# EasyEDA Pro project Jarvis.eprj, schematic Schematic8_1
Board Name: MotherBoard_1; Create Date: 2026-04-19; Page Name: P1; Project Name: Jarvis; Schematic Name: Schematic8_1; Update Date: 2026-04-19; Company: EasyEDA.com; Page Size: A4; Version: V1.0
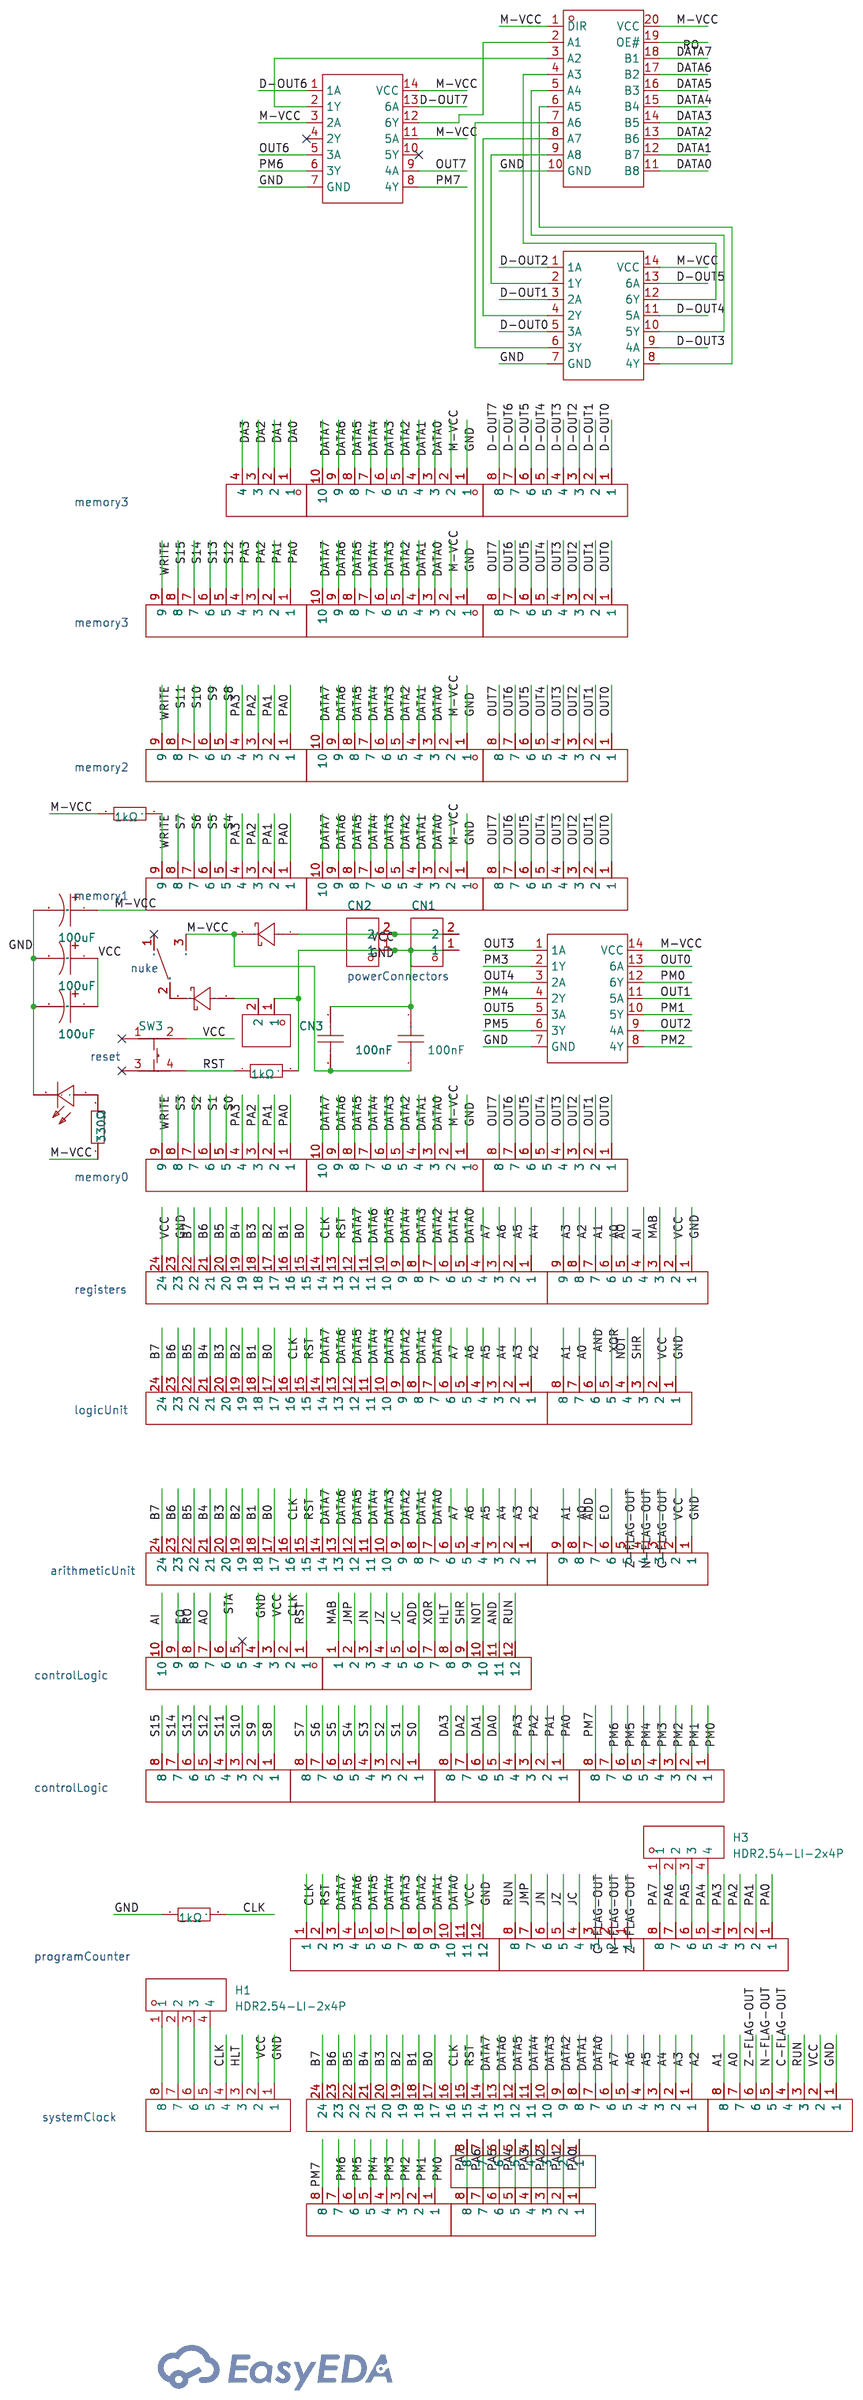
[diagram p8: schematic sheet]

## Parts
C40  100uF  [CAP-TH_BD6.3-P2.50-D1.0-FD]
C66  100nF  [CAP-TH_L5.0-W2.5-P5.00-D1.0]
C67  100nF  [CAP-TH_L5.0-W2.5-P5.00-D1.0]
C68  100uF  [CAP-TH_BD6.3-P2.50-D1.0-FD]
C69  100uF  [CAP-TH_BD6.3-P2.50-D1.0-FD]
CN1  MX7620-7.62-02P-BK01-Cu-S-A  [CONN-TH_2P-P7.62_MX7620-7.62-02P-BK01-CU-S-A]
CN2  MX7620-7.62-02P-BK01-Cu-S-A  [CONN-TH_2P-P7.62_MX7620-7.62-02P-BK01-CU-S-A]
CN3  MX7620-7.62-02P-BK01-Cu-S-A  [CONN-TH_2P-P7.62_MX7620-7.62-02P-BK01-CU-S-A]
H1  HDR2.54-LI-2x4P  [HDR-TH_4P-P2.54-V-M]
H2  HDR2.54-LI-2x4P  [HDR-TH_4P-P2.54-V-M]
H3  HDR2.54-LI-2x4P  [HDR-TH_4P-P2.54-V-M]
R59  1kΩ  [RES-TH_BD2.3-L6.5-P10.50-D0.5]
R61  1kΩ  [RES-TH_BD2.3-L6.5-P10.50-D0.5]
R62  1kΩ  [RES-TH_BD2.3-L6.5-P10.50-D0.5]
R63  330Ω  [RES-TH_BD2.3-L6.5-P10.50-D0.5]
SW3  B3F-1000-S  [KEY-TH_4P-L6.2-W6.2-P4.50-LS6.5]
U5  SN74HC245N3  [PDIP-20_L25.9-W6.6-P2.54-LS7.9-BL]
U7  TH2.54_8P_0.6  [HDR-TH_8P-P2.54-V-M-3]
U8  TH2.54_8P_0.6  [HDR-TH_8P-P2.54-V-M-3]
U210  SN74HC04N(LX)  [DIP-14_L19.6-W6.4-P2.54-LS7.6-BL]
U356  TH2.54_8P_0.6  [HDR-TH_8P-P2.54-V-M-3]
U377  HDR2.54-LI-9P  [HDR-TH_9P-P2.54-V-M]
U382  TH2.54_8P_0.6  [HDR-TH_8P-P2.54-V-M-3]
U384  TH2.54-24P排针(母)(邮寄专用)  [HDR-TH_24P-P2.54-V-F]
U385  cn10_2r54_10x1  [HDR-TH_10P-P2.54-V-F]
U386  D22030200553-HDR-TH_12P-P2.54-V-F  [HDR-TH_12P-P2.54-V-F]
U387  TH2.54_8P_0.6  [HDR-TH_8P-P2.54-V-M-3]
U388  TH2.54_8P_0.6  [HDR-TH_8P-P2.54-V-M-3]
U390  HDR2.54-LI-9P  [HDR-TH_9P-P2.54-V-M]
U400  TH2.54_8P_0.6  [HDR-TH_8P-P2.54-V-M-3]
U410  cn10_2r54_10x1  [HDR-TH_10P-P2.54-V-F]
U411  D22030200553-HDR-TH_12P-P2.54-V-F  [HDR-TH_12P-P2.54-V-F]
U412  TH2.54-24P排针(母)(邮寄专用)  [HDR-TH_24P-P2.54-V-F]
U413  HDR2.54-LI-9P  [HDR-TH_9P-P2.54-V-M]
U415  HDR2.54-LI-9P  [HDR-TH_9P-P2.54-V-M]
U416  cn10_2r54_10x1  [HDR-TH_10P-P2.54-V-F]
U417  TH2.54_8P_0.6  [HDR-TH_8P-P2.54-V-M-3]
U418  HDR2.54-LI-9P  [HDR-TH_9P-P2.54-V-M]
U419  cn10_2r54_10x1  [HDR-TH_10P-P2.54-V-F]
U420  TH2.54_8P_0.6  [HDR-TH_8P-P2.54-V-M-3]
U421  HDR2.54-LI-9P  [HDR-TH_9P-P2.54-V-M]
U422  cn10_2r54_10x1  [HDR-TH_10P-P2.54-V-F]
U423  TH2.54_8P_0.6  [HDR-TH_8P-P2.54-V-M-3]
U424  TH2.54-24P排针(母)(邮寄专用)  [HDR-TH_24P-P2.54-V-F]
U426  TH2.54_8P_0.6  [HDR-TH_8P-P2.54-V-M-3]
U427  TH2.54_8P_0.6  [HDR-TH_8P-P2.54-V-M-3]
U431  cn10_2r54_10x1  [HDR-TH_10P-P2.54-V-F]
U432  TH2.54_8P_0.6  [HDR-TH_8P-P2.54-V-M-3]
U434  1N4007-DIODE  [DO-41_BD2.4-L4.7-P8.70-D0.8-FD]
U436  1N4007-DIODE  [DO-41_BD2.4-L4.7-P8.70-D0.8-FD]
U437  7105T1ZQE  [SW-TH_3P-L12.7-W6.8-P4.70]
U438  TH2.54-24P排针(母)(邮寄专用)  [HDR-TH_24P-P2.54-V-F]
U439  TH2.54_8P_0.6  [HDR-TH_8P-P2.54-V-M-3]
U440  TH2.54_8P_0.6  [HDR-TH_8P-P2.54-V-M-3]
U441  TH2.54_8P_0.6  [HDR-TH_8P-P2.54-V-M-3]
U442  LED  [LED-TH_BD4.0-P2.54-FD_RED]
U443  TH2.54_8P_0.6  [HDR-TH_8P-P2.54-V-M-3]
U444  SN74HC04N(LX)  [DIP-14_L19.6-W6.4-P2.54-LS7.6-BL]
U445  SN74HC04N(LX)  [DIP-14_L19.6-W6.4-P2.54-LS7.6-BL]

## Library data of the parts
C40 C68 C69 = NXA35VB100M6.3*11_LO: LCSC Part Name: 100uF 35V; Supplier Part: C346956; Supplier Footprint: 插件,6.3x11mm; JLCPCB Part Class: Extended Part; Supplier: LCSC
C66 C67 = 178MU0006: LCSC Part Name: 100nF ±10% 50V; Supplier Part: C5632430; Manufacturer: KNSCHA(科尼盛); Supplier Footprint: 插件,P=2.54mm; JLCPCB Part Class: Extended Part; Datasheet: https://item.szlcsc.com/datasheet/178MU0006/6552585.html; Supplier: LCSC; Tolerance: ±10%; Voltage Rating: 50V; Temperature Coefficient: X7R; Pin Spacing: 2.54mm
CN1-CN3 = MX7620-7.62-02P-BK01-Cu-S-A: LCSC Part Name: 7.62mm 1x2P 直插 边脚 排数:1 每排P数:2; Supplier Part: C5188500; Manufacturer: MAX(迈旭); Supplier Footprint: 插件,P=7.62mm; JLCPCB Part Class: Extended Part; Datasheet: https://item.szlcsc.com/datasheet/MX7620-7.62-02P-BK01-Cu-S-A/5862584.html; Supplier: LCSC; Barrier Type: 2-Side; Pitch: 7.62mm; Number of Positions or Pins: 1x2P; Mounting Type: Straight; Pin Location: Side Mount; Number of Pins: 2P; Number of Rows: 1; Number of PINs Per Row: 2; Screw Specification: M3; Current Rating: 20A; Voltage Rating (Max): 300V; Wire Gauge - AWG: 12~22; Wire Gauge - mm2: 2.5; Operating Temperature: -40℃~+105℃; Color: Black
H1-H3 = HDR2.54-LI-2x4P: Supplier Part: C9900020145; JLCPCB Part Class: Extended Part; Supplier: LCSC
R59 R61-R63 = MF1/4W-1KΩ±1%T52: Type:Metal Film Resistors Resistance: Tolerance:±1% Tolerance:±1% Power(Watts):250mW Temperature Coefficient:±200ppm/℃ Temperature Coefficient:±200ppm/℃; LCSC Part Name: 金属膜电阻 1kΩ ±1% 250mW; Supplier Part: C713997; Manufacturer: 华星机电; Supplier Footprint: 插件,D2.3xL6.5mm; JLCPCB Part Class: Extended Part; Datasheet: https://atta.szlcsc.com/upload/public/pdf/source/20200731/C713882_AE8EB1102749D7E4FB4FB13DC898C429.pdf; Supplier: LCSC; Type: Metal Film Resistors; Tolerance: ±1%; Power(Watts): 250mW; Temperature Coefficient: ±200ppm/℃
SW3 = B3F-1000-S: Supplier Part: C19724130; Manufacturer: OMRON(欧姆龙); Supplier Footprint: SW-TH_4P; JLCPCB Part Class: Extended Part; Datasheet: https://item.szlcsc.com/datasheet/B3F-1000-S/21045793.html; Supplier: LCSC
U5 = SN74HC245N3: Supplier Part: C3587488; Manufacturer: TI(德州仪器); Supplier Footprint: PDIP-20; JLCPCB Part Class: Extended Part; Datasheet: https://item.szlcsc.com/datasheet/SN74HC245N3/4154202.html; Supplier: LCSC; output type: Tri-State; Voltage - Supply: 2V~6V; Number of Elements: 1; Number of Bits per Element: 8; Channel Type: Bidirectional; Current - Output Low(IOL): 7.8mA; Current - Output High(IOH): 7.8mA; Logic Family: 74HC; Operating Temperature: -40℃~+85℃; Quiescent Current: 80uA; Propagation Delay: 21ns@4.5V,50pF
U7 U8 U356 U382 U387 U388 U400 U417 U420 U423 U426 U427 U432 U439-U441 U443 = TH2.54_8P_0.6: Supplier Part: C9900018349; Supplier Footprint: HDR-TH-8P; JLCPCB Part Class: Extended Part; Supplier: LCSC
U210 U444 U445 = SN74HC04N(LX): LCSC Part Name: 集成电路; Supplier Part: C22436641; Manufacturer: LX(灵星芯微); Supplier Footprint: DIP-14; JLCPCB Part Class: Extended Part; Datasheet: https://item.szlcsc.com/datasheet/SN74HC04N(LX)/24070577.html; Supplier: LCSC; Voltage - Supply: 2V~6V; Quiescent Current(Iq): 2uA; Number of Circuits: 6; Input Logic Level - High: 1.5V~4.2V; Input Logic Level -Low: 500mV~1.8V; Output Logic Level - High: 4.4V；5.9V；1.9V; Output Logic Level - Low: 260mV；260mV；100mV; Propagation Delay: 14ns@6V,50pF; Series: 74HC Series; Operating Temperature: -40℃~+125℃
U377 U390 U413 U415 U418 U421 = HDR2.54-LI-9P: Supplier Part: C9900020142; JLCPCB Part Class: Extended Part; Supplier: LCSC
U384 U412 U424 U438 = TH2.54-24P排针(母)(邮寄专用): Supplier Part: C9900014057; Supplier Footprint: HDR-TH_24P-P2.54-V-M; JLCPCB Part Class: Extended Part; Supplier: LCSC
U385 U410 U416 U419 U422 U431 = cn10_2r54_10x1: Supplier Part: C9900001415; JLCPCB Part Class: Extended Part; Supplier: LCSC
U386 U411 = D22030200553-HDR-TH_12P-P2.54-V-F: Supplier Part: C9900009321; JLCPCB Part Class: Extended Part; Supplier: LCSC
U434 U436 = 1N4007-DIODE: Supplier Part: C9900005663; Supplier Footprint: DO-41; JLCPCB Part Class: Extended Part; Supplier: LCSC
U437 = 7105T1ZQE: LCSC Part Name: 五件套 微型钮子开关; Supplier Part: C2689624; Manufacturer: C&K; JLCPCB Part Class: Extended Part; Datasheet: https://atta.szlcsc.com/upload/public/pdf/source/20210426/C2689507_05C32A915E25962046835BB80E46C6CA.pdf; Supplier: LCSC; Circuit: Single Pole Double Throw (SPDT); Voltage Rating (AC): 120V; Voltage Rating (DC): 28V; Actuator Type: Cylinder knob; Termination Style: Solder; Mounting Type: Direct Insert; Operating Temperature: -30℃~+85℃
U442 = LED: Supplier Part: C9900015665; Supplier Footprint: SIP-2P; JLCPCB Part Class: Extended Part; Supplier: LCSC

## Nets
GND: C40.2 C66.1 C67.1 C68.2 C69.2 CN1.1 CN2.1 CN3.1 R61.2 R62.1 U5.10(GND) U210.7(GND) U382.1 U385.1 U386.12 U390.1 U410.4 U412.23 U413.1 U416.1 U419.1 U422.1 U427.1 U431.1 U439.1 U442.2(-) U444.7(GND) U445.7(GND)
VCC: C40.1 C68.1 CN1.2 CN2.2 SW3.2 U382.2 U386.11 U390.2 U410.3 U412.24 U413.2 U427.2 U434.1(A) U439.2
A0: U382.7 U390.8 U413.6 U439.7
A1: U382.8 U390.9 U413.7 U439.8
A2: U384.1 U413.8 U424.1 U438.1
A3: U384.2 U413.9 U424.2 U438.2
A4: U384.3 U412.1 U424.3 U438.3
A5: U384.4 U412.2 U424.4 U438.4
A6: U384.5 U412.3 U424.5 U438.5
A7: U384.6 U412.4 U424.6 U438.6
ADD: U390.7 U411.6
AI: U410.10 U413.4
AND: U382.6 U411.11
AO: U410.7 U413.5
B0: U384.17 U412.15 U424.17 U438.17
B1: U384.18 U412.16 U424.18 U438.18
B2: U384.19 U412.17 U424.19 U438.19
B3: U384.20 U412.18 U424.20 U438.20
B4: U384.21 U412.19 U424.21 U438.21
B5: U384.22 U412.20 U424.22 U438.22
B6: U384.23 U412.21 U424.23 U438.23
B7: U384.24 U412.22 U424.24 U438.24
C-FLAG-OUT: U390.3 U426.3 U439.4
CLK: R62.2 U384.16 U386.1 U410.2 U412.14 U424.16 U427.4 U438.16
D-OUT0: U432.1 U444.5(3A)
D-OUT1: U432.2 U444.3(2A)
D-OUT2: U432.3 U444.1(1A)
D-OUT3: U432.4 U444.9(4A)
D-OUT4: U432.5 U444.11(5A)
D-OUT5: U432.6 U444.13(6A)
D-OUT6: U432.7 U445.1(1A)
D-OUT7: U432.8 U445.13(6A)
DA0: H2.1 U400.5
DA1: H2.2 U400.6
DA2: H2.3 U400.7
DA3: H2.4 U400.8
DATA0: U5.11(B8) U384.7 U385.3 U386.10 U412.5 U416.3 U419.3 U422.3 U424.7 U431.3 U438.7
DATA1: U5.12(B7) U384.8 U385.4 U386.9 U412.6 U416.4 U419.4 U422.4 U424.8 U431.4 U438.8
DATA2: U5.13(B6) U384.9 U385.5 U386.8 U412.7 U416.5 U419.5 U422.5 U424.9 U431.5 U438.9
DATA3: U5.14(B5) U384.10 U385.6 U386.7 U412.8 U416.6 U419.6 U422.6 U424.10 U431.6 U438.10
DATA4: U5.15(B4) U384.11 U385.7 U386.6 U412.9 U416.7 U419.7 U422.7 U424.11 U431.7 U438.11
DATA5: U5.16(B3) U384.12 U385.8 U386.5 U412.10 U416.8 U419.8 U422.8 U424.12 U431.8 U438.12
DATA6: U5.17(B2) U384.13 U385.9 U386.4 U412.11 U416.9 U419.9 U422.9 U424.13 U431.9 U438.13
DATA7: U5.18(B1) U384.14 U385.10 U386.3 U412.12 U416.10 U419.10 U422.10 U424.14 U431.10 U438.14
EO: U390.6 U410.9
HLT: U411.8 U427.3
JC: U411.5 U426.4
JMP: U411.2 U426.7
JN: U411.3 U426.6
JZ: U411.4 U426.5
M-VCC: C66.2 C67.2 C69.1 R59.1 R63.1 U5.1(DIR) U5.20(VCC) U210.14(VCC) U385.2 U416.2 U419.2 U422.2 U431.2 U434.2(K) U437.3(NC) U444.14(VCC) U445.3(2A) U445.11(5A) U445.14(VCC)
MAB: U411.1 U413.3
N-FLAG-OUT: U390.4 U426.2 U439.5
NOT: U382.4 U411.10
OUT0: U210.13(6A) U356.1 U417.1 U420.1 U423.1
OUT1: U210.11(5A) U356.2 U417.2 U420.2 U423.2
OUT2: U210.9(4A) U356.3 U417.3 U420.3 U423.3
OUT3: U210.1(1A) U356.4 U417.4 U420.4 U423.4
OUT4: U210.3(2A) U356.5 U417.5 U420.5 U423.5
OUT5: U210.5(3A) U356.6 U417.6 U420.6 U423.6
OUT6: U356.7 U417.7 U420.7 U423.7 U445.5(3A)
OUT7: U356.8 U417.8 U420.8 U423.8 U445.9(4A)
PA0: U377.1 U387.1 U400.1 U415.1 U418.1 U421.1 U441.1 U443.1
PA1: U377.2 U387.2 U400.2 U415.2 U418.2 U421.2 U441.2 U443.2
PA2: U377.3 U387.3 U400.3 U415.3 U418.3 U421.3 U441.3 U443.3
PA3: U377.4 U387.4 U400.4 U415.4 U418.4 U421.4 U441.4 U443.4
PA4: H3.4 U387.5 U441.5 U443.5
PA5: H3.3 U387.6 U441.6 U443.6
PA6: H3.2 U387.7 U441.7 U443.7
PA7: H3.1 U387.8 U441.8 U443.8
PM0: U210.12(6Y) U388.1 U440.1
PM1: U210.10(5Y) U388.2 U440.2
PM2: U210.8(4Y) U388.3 U440.3
PM3: U210.2(1Y) U388.4 U440.4
PM4: U210.4(2Y) U388.5 U440.5
PM5: U210.6(3Y) U388.6 U440.6
PM6: U388.7 U440.7 U445.6(3Y)
PM7: U388.8 U440.8 U445.8(4Y)
RO: U5.19(OE#) U410.8
RST: R61.1 SW3.4 U384.15 U386.2 U410.1 U412.13 U424.15 U438.15
RUN: U411.12 U426.8 U439.3
S0: U7.1 U377.5
S1: U7.2 U377.6
S2: U7.3 U377.7
S3: U7.4 U377.8
S4: U7.5 U415.5
S5: U7.6 U415.6
S6: U7.7 U415.7
S7: U7.8 U415.8
S8: U8.1 U418.5
S9: U8.2 U418.6
S10: U8.3 U418.7
S11: U8.4 U418.8
S12: U8.5 U421.5
S13: U8.6 U421.6
S14: U8.7 U421.7
S15: U8.8 U421.8
SHR: U382.3 U411.9
STA: U410.6
WRITE: R59.2 U377.9 U415.9 U418.9 U421.9
XOR: U382.5 U411.7
Z-FLAG-OUT: U390.5 U426.1 U439.6
$1N2918: H1.4 U427.5
$1N2920: H1.3 U427.6
$1N2922: H1.2 U427.7
$1N2924: H1.1 U427.8
$1N4906: U436.2(K) U437.2(COMM)
$1N9603: CN3.2 U436.1(A)
$1N9846: R63.2 U442.1(+)
$1N13836: U5.9(A8) U444.2(1Y)
$1N13845: U5.8(A7) U444.4(2Y)
$1N13855: U5.7(A6) U444.6(3Y)
$1N13879: U5.6(A5) U444.8(4Y)
$1N13894: U5.5(A4) U444.10(5Y)
$1N13905: U5.4(A3) U444.12(6Y)
$1N14102: U5.3(A2) U445.2(1Y)
$1N14284: U5.2(A1) U445.12(6Y)

Not connected (* = marked no-connect by the designer): SW3 1* 3*; U410 5*; U437 1(ON)*; U445 4(2Y)* 10(5Y)*

## Notes on the sheet
- memory3
- memory3
- memory2
- memory1
- nuke
- powerConnectors
- reset
- memory0
- registers
- logicUnit
- arithmeticUnit
- controlLogic
- controlLogic
- programCounter
- systemClock
